# EasyEDA Pro project ProProject_Avaota Pi A_2024-03-25.epro, schematic Avaota Pi A, sheets 1 to 5 of 13 (continued)
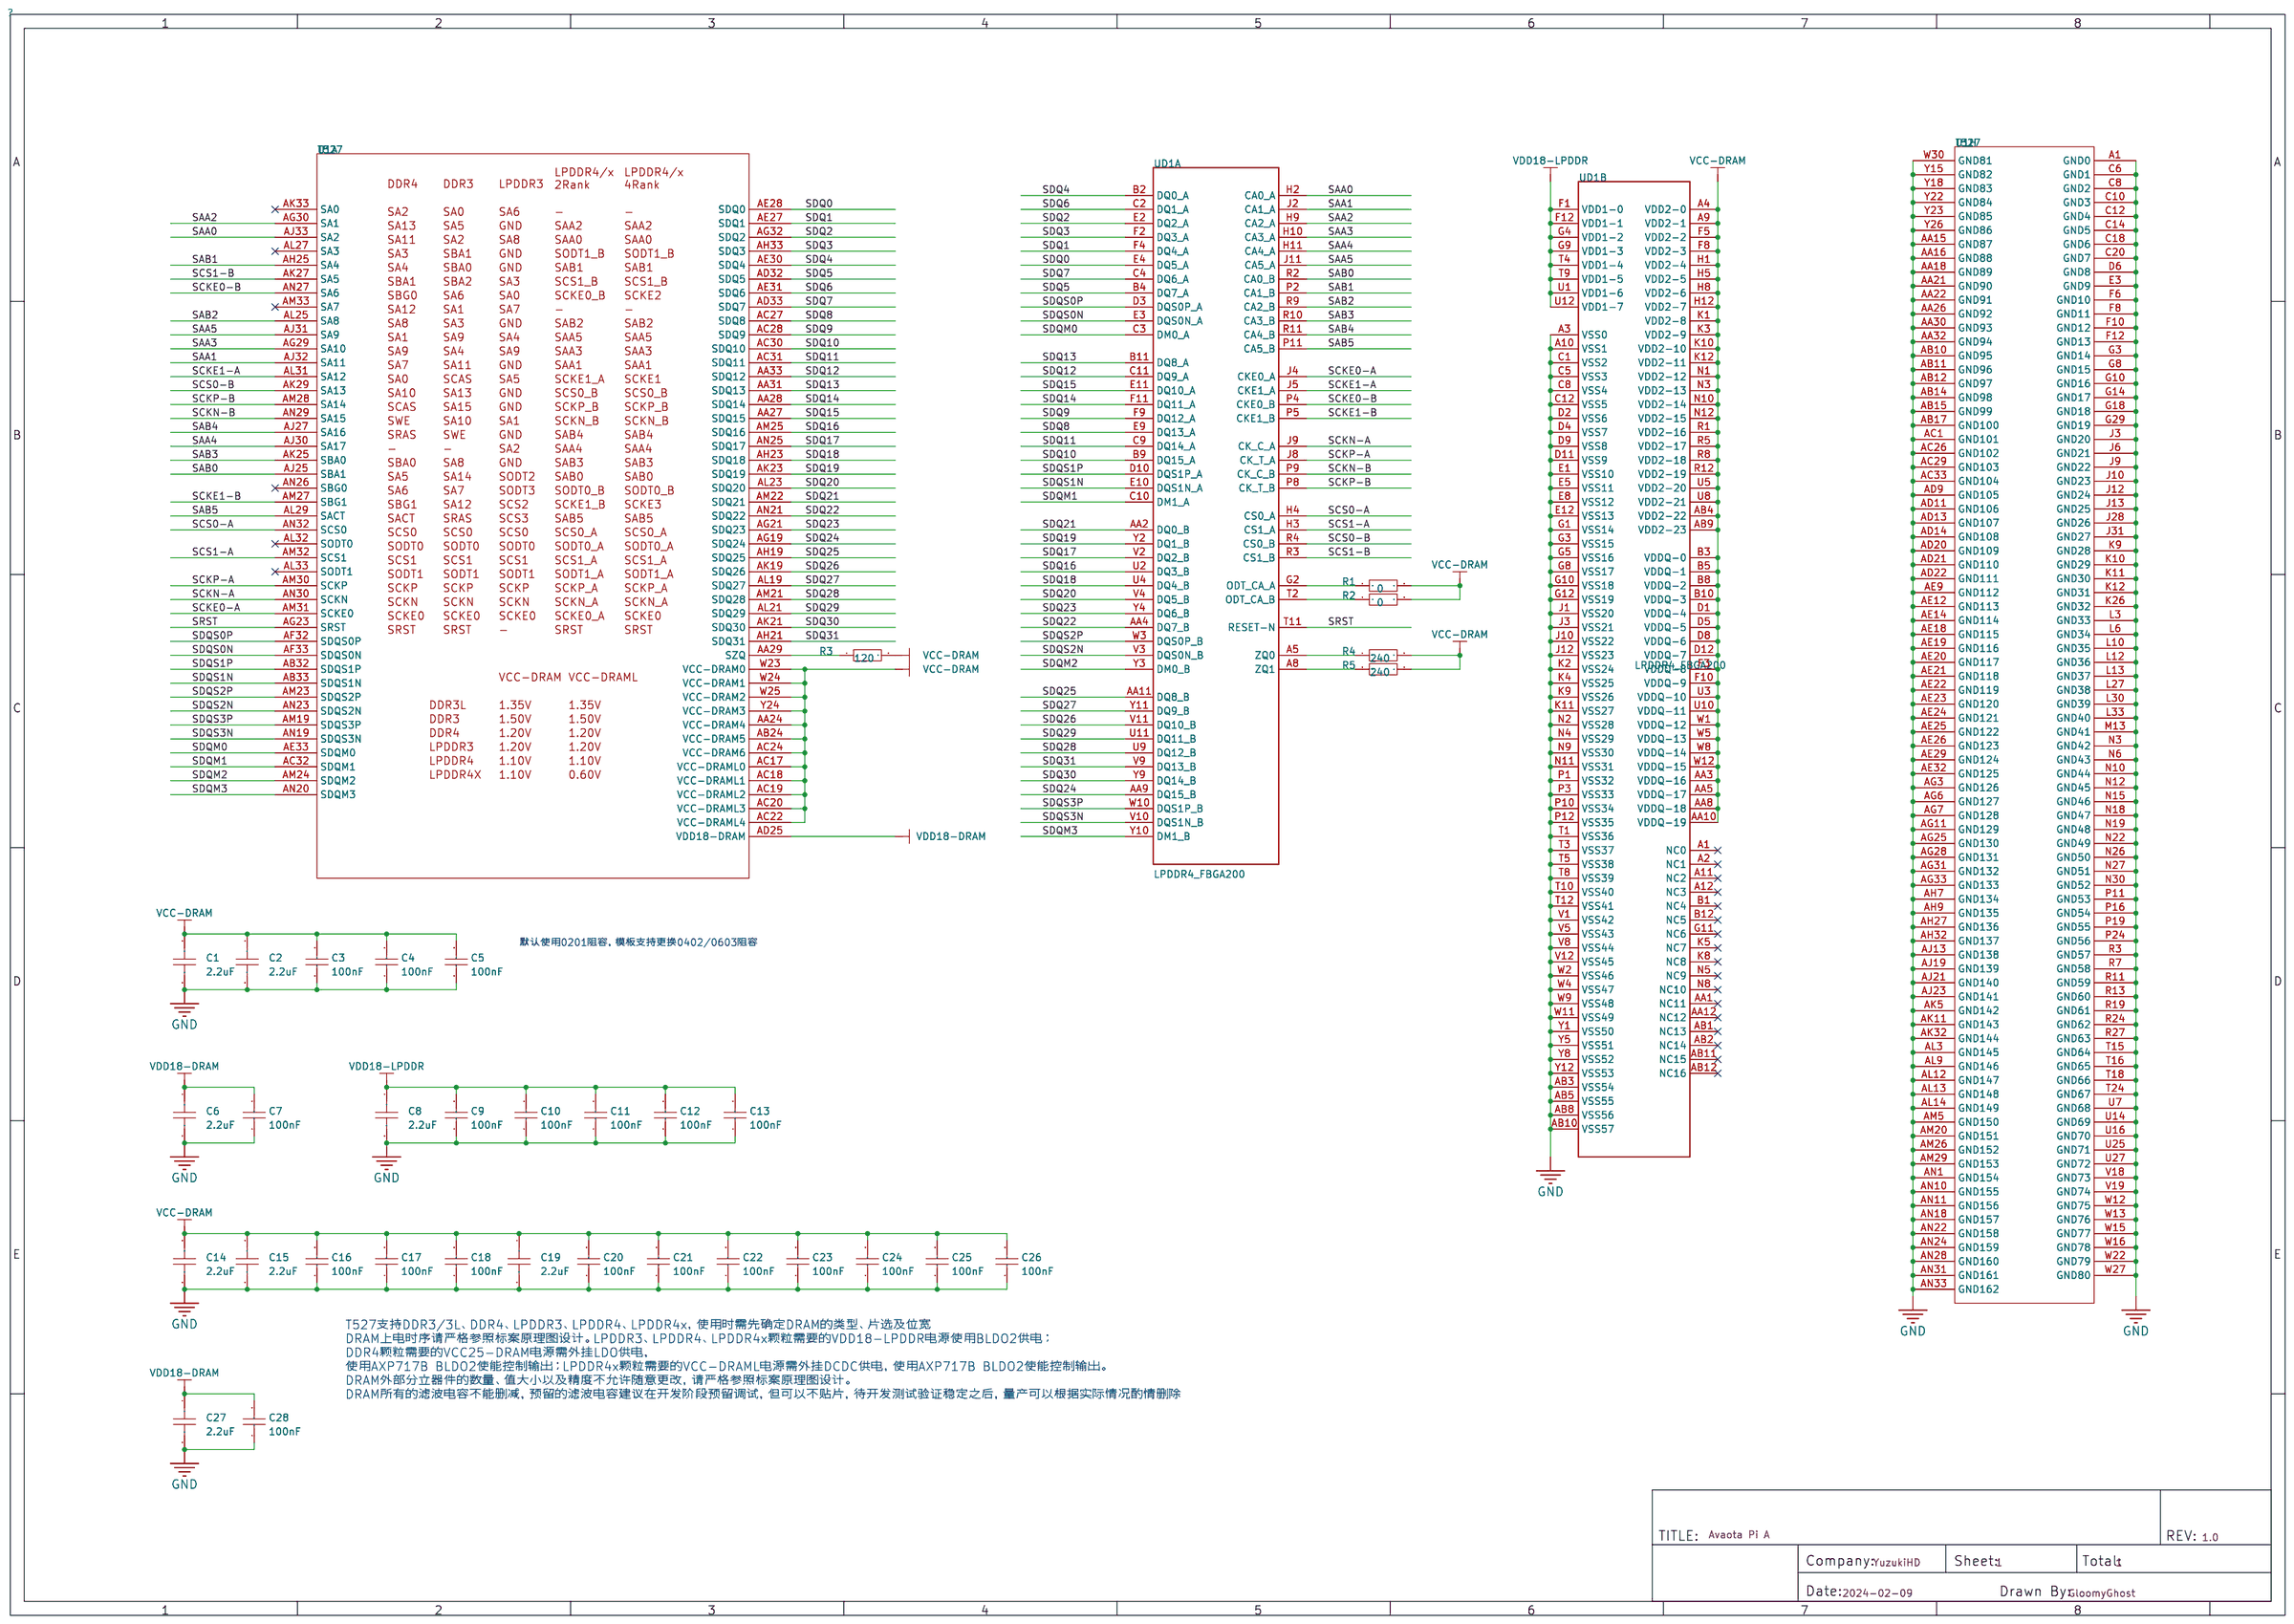
[diagram p0: schematic sheet]
## Nets (continued)
BLDO3: C63.1 C104.2 C185.2 C186.2 C187.2 C188.2 U4.21(BLDO3) U14.AJ5(CPVIN) U14.K13(VCC-MCSI) U14.M10(VCC-PK) ; also on sheet 6 13
BLDO4: C65.1 U4.22(BLDO4)
BOOT-SEL-ADC: R30.1 R33.2 U14.W1(GPADC0)
BT-RESETN: U14.U3(PG12/I2S1-LRCK/PG-EINT12) ; also on sheet 12
BT-WAKE-AP: U14.U5(PG10/I2S1-MCLK/PG-EINT10) ; also on sheet 12
CAN-RX0: U14.AJ17(PI16/UART3-CTS/TWI2-SDA/PWM-17/CAN-RX0/PI-EINT16) ; also on sheet 12
CAN-TX0: U14.AH17(PI15/UART3-RTS/TWI2-SCK/PWM-16/CAN-TX0/PI-EINT15) ; also on sheet 12
CLDO1: C60.2 C163.2 C164.2 U4.23(CLDO1) U14.U26(VCC-PC) ; also on sheet 8
CLDO2: C62.2 C91.2 U4.24(CLDO2) U14.R26(VCC-EFUSE)
CLDO3: C64.2 C102.2 C173.2 C174.2 U4.26(CLDO3) U14.AC9(VDD33) U14.L15(VCC-IO) ; also on sheet 6 8 9 10 12
CLDO4: C66.2 U4.27(CLDO4)
CPUSLDO: C13.1 C14.1 C35.2 U4.28(CPUSLDO) U14.AC15(VDD-CPUS)
CPUX-RX: U14.R29(PB10/UART0-RX/TWI0-SDA/PWM-1/I2S0-DIN3/I2S0-DOUT3/PB-EINT10) ; also on sheet 6 8
CPUX-TX: U14.R28(PB9/UART0-TX/TWI0-SCK/TRACE-DATA1/I2S0-DIN2/I2S0-DOUT2/PB-EINT9) ; also on sheet 6 8
CPVDD: C105.2 U14.AJ3(CPVDD)
CPVEE: C115.2 U14.AJ4(VEE) U14.AK2(CPVEE)
CTP-INT: U14.R31(PB12/TWI5-SDA/UART7-CTS/SPI1-CLK/PWM-3/PB-EINT12) ; also on sheet 8
CTP-RST: U14.R30(PB11/TWI5-SCK/UART7-RTS/SPI1-CS0/PWM-2/PB-EINT11) ; also on sheet 8
CTP-SCK: U14.R32(PB13/TWI4-SCK/UART7-TX/SPI1-MOSI/PWM-4/PB-EINT13) ; also on sheet 8
CTP-SDA: U14.R33(PB14/TWI4-SDA/UART7-RX/SPI1-MISO/PWM-5/PB-EINT14) ; also on sheet 8
DCDC1: C15.2 C16.2 C36.1 C37.1 C38.1 C39.1 C40.1 C41.1 C288.2 C289.2 L2.2 U14.W19(VDD-CPUL0) U14.W21(VDD-CPUL1) U14.Y19(VDD-CPUL2) U14.Y21(VDD-CPUL3)
DCDC2: C18.2 C25.2 C47.1 C48.1 C49.1 C50.1 C57.1 C58.1 C67.1 C68.1 C75.1 C76.1 C77.1 C78.1 C290.2 C291.2 L3.2 U14.N13(VDD-VE0) U14.N21(VDD-DE0) U14.P13(VDD-VE1) U14.P21(VDD-DE1) U14.P22(VDD-DE2) U14.R15(VDD-SYS0) U14.R17(VDD-SYS1) U14.R18(VDD-SYS2) U14.T11(VDD-GPU0) U14.T13(VDD-GPU1) U14.U12(VDD-GPU2) U14.U13(VDD-GPU3) ; also on sheet 6
DCDC3: C31.2 C33.2 C116.1 C117.1 C118.2 C119.2 C120.2 C121.2 C122.2 C123.2 C124.2 C125.2 C126.2 C127.2 C128.2 C129.2 C130.2 C131.2 C142.1 C143.1 C144.2 C145.2 C146.2 C147.1 C148.2 C149.2 C150.2 C151.2 C152.2 C153.2 C154.2 C155.2 C156.2 C157.2 C158.2 C159.2 C160.2 C292.2 C293.2 L4.2 R36.2 R37.2 R38.2 R39.2 R40.2 U4.29(FB3) U14.AA24(VCC-DRAM4) U14.AB24(VCC-DRAM5) U14.AC17(VCC-DRAML0) U14.AC18(VCC-DRAML1) U14.AC19(VCC-DRAML2) U14.AC20(VCC-DRAML3) U14.AC22(VCC-DRAML4) U14.AC24(VCC-DRAM6) U14.W23(VCC-DRAM0) U14.W24(VCC-DRAM1) U14.W25(VCC-DRAM2) U14.Y24(VCC-DRAM3) UD1.A4(VDD2-0) UD1.A9(VDD2-1) UD1.AA3(VDDQ-16) UD1.AA5(VDDQ-17) UD1.AA8(VDDQ-18) UD1.AA10(VDDQ-19) UD1.AB4(VDD2-22) UD1.AB9(VDD2-23) UD1.B3(VDDQ-0) UD1.B5(VDDQ-1) UD1.B8(VDDQ-2) UD1.B10(VDDQ-3) UD1.D1(VDDQ-4) UD1.D5(VDDQ-5) UD1.D8(VDDQ-6) UD1.D12(VDDQ-7) UD1.F3(VDDQ-8) UD1.F5(VDD2-2) UD1.F8(VDD2-3) UD1.F10(VDDQ-9) UD1.H1(VDD2-4) UD1.H5(VDD2-5) UD1.H8(VDD2-6) UD1.H12(VDD2-7) UD1.K1(VDD2-8) UD1.K3(VDD2-9) UD1.K10(VDD2-10) UD1.K12(VDD2-11) UD1.N1(VDD2-12) UD1.N3(VDD2-13) UD1.N10(VDD2-14) UD1.N12(VDD2-15) UD1.R1(VDD2-16) UD1.R5(VDD2-17) UD1.R8(VDD2-18) UD1.R12(VDD2-19) UD1.U3(VDDQ-10) UD1.U5(VDD2-20) UD1.U8(VDD2-21) UD1.U10(VDDQ-11) UD1.W1(VDDQ-12) UD1.W5(VDDQ-13) UD1.W8(VDDQ-14) UD1.W12(VDDQ-15)
DCDC4: C32.1 C34.1 C42.1 C167.2 C168.2 C169.2 C170.2 C175.2 C176.2 C177.2 C178.2 L5.1 R14.1 U14.AE16(VCC-PI) U14.L9(VCC-PE) U14.L26(VCC-PD) U14.P9(VCC-PJ) ; also on sheet 6 8 9 10 12 13
DCXO-XIN: C99.2 U14.AM13(DXIN) X1.1(OSC1)
DCXO-XOUT: C98.2 U14.AN13(DXOUT) X1.3(OSC2)
DDR-PARA-SEL-ADC1: R31.1 R34.2 U14.W2(GPADC1)
DDR-PARA-SEL-ADC2: R32.1 R35.2 U14.W3(GPADC2)
DSP-UART-RX: U14.AN2(PM1/S-UART0-RX/S-UART1-RX/S-PWM-3/S-PM-EINT1) ; also on sheet 8
DSP-UART-TX: U14.AN3(PM0/S-UART0-TX/S-UART1-TX/S-PWM-2/S-PM-EINT0) ; also on sheet 8
FEL: C96.2 R22.2 U14.F16(FEL)
HBIAS: U14.AL1(HBIAS) ; also on sheet 12
HP-DET: U14.AJ2(HP-DET) ; also on sheet 12
HPOUTFB: U14.AM1(HPOUTFB) ; also on sheet 12
HPOUTL: U14.AL2(HPOUTL) ; also on sheet 12
HPOUTR: U14.AM2(HPOUTR) ; also on sheet 12
IR-RX: U14.AL16(PI8/TWI5-SCK/IR-RX/PWM-9/SPI2-MOSI/PI-EINT8) ; also on sheet 12
LCD0-CLK: U14.K31(PD18/LCD0-CLK/LVDS1-D3P/DSI1-D3P/PWM-18/UART4-TX/PD-EINT18) ; also on sheet 8
LCD0-D0: U14.N28(PB0/UART2-TX/SPI2-CS0/JTAG-MS/LCD0-D0/PWM-6/PB-EINT0) ; also on sheet 8
LCD0-D1: U14.N29(PB1/UART2-RX/SPI2-CLK/JTAG-CK/LCD0-D1/PWM-7/PB-EINT1) ; also on sheet 8
LCD0-D2: U14.D32(PD0/LCD0-D2/LVDS0-D0P/DSI0-D0P/PWM-0/PD-EINT0) ; also on sheet 8
LCD0-D3: U14.D33(PD1/LCD0-D3/LVDS0-D0N/DSI0-D0N/PWM-1/PD-EINT1) ; also on sheet 8
LCD0-D4: U14.E30(PD2/LCD0-D4/LVDS0-D1P/DSI0-D1P/PWM-2/PD-EINT2) ; also on sheet 8
LCD0-D5: U14.E31(PD3/LCD0-D5/LVDS0-D1N/DSI0-D1N/PWM-3/PD-EINT3) ; also on sheet 8
LCD0-D6: U14.E32(PD4/LCD0-D6/LVDS0-D2P/DSI0-CKP/PWM-4/PD-EINT4) ; also on sheet 8
LCD0-D7: U14.E33(PD5/LCD0-D7/LVDS0-D2N/DSI0-CKN/PWM-5/PD-EINT5) ; also on sheet 8
LCD0-D8: U14.M31(PB2/UART2-RTS/SPI2-MOSI/JTAG-DO/LCD0-D8/CAN-TX0/PB-EINT2) ; also on sheet 8
LCD0-D9: U14.M32(PB3/UART2-CTS/SPI2-MISO/JTAG-DI/LCD0-D9/CAN-RX0/PB-EINT3) ; also on sheet 8
LCD0-D10: U14.F32(PD6/LCD0-D10/LVDS0-CKP/DSI0-D2P/PWM-6/PD-EINT6) ; also on sheet 8
LCD0-D11: U14.F33(PD7/LCD0-D11/LVDS0-CKN/DSI0-D2N/PWM-7/PD-EINT7) ; also on sheet 8
LCD0-D12: U14.G30(PD8/LCD0-D12/LVDS0-D3P/DSI0-D3P/PWM-8/PD-EINT8) ; also on sheet 8
LCD0-D13: U14.G31(PD9/LCD0-D13/LVDS0-D3N/DSI0-D3N/PWM-9/PD-EINT9) ; also on sheet 8
LCD0-D14: U14.G32(PD10/LCD0-D14/LVDS1-D0P/DSI1-D0P/PWM-10/SPI1-CS0/DBI-CSX/PD-EINT10) ; also on sheet 8
LCD0-D15: U14.G33(PD11/LCD0-D15/LVDS1-D0N/DSI1-D0N/PWM-11/SPI1-CLK/DBI-SCLK/PD-EINT11) ; also on sheet 8
LCD0-D16: U14.P31(PB7/OWA-IN/I2S0-DOUT0/I2S0-DIN1/LCD0-D16/PWM-11/PB-EINT7) ; also on sheet 8
LCD0-D17: U14.P32(PB8/OWA-OUT/I2S0-DIN0/I2S0-DOUT1/LCD0-D17/PWM-0/PB-EINT8) ; also on sheet 8
LCD0-D18: U14.H31(PD12/LCD0-D18/LVDS1-D1P/DSI1-D1P/PWM-12/SPI1-MOSI/DBI-SDO/PD-EINT12) ; also on sheet 8
LCD0-D19: U14.H32(PD13/LCD0-D19/LVDS1-D1N/DSI1-D1N/PWM-13/SPI1-MISO/DBI-SDI/DBI-TE/DBI-DCX/PD-EINT13) ; also on sheet 8
LCD0-D20: U14.J29(PD14/LCD0-D20/LVDS1-D2P/DSI1-CKP/PWM-14/UART3-TX/PD-EINT14) ; also on sheet 8
LCD0-D21: U14.J30(PD15/LCD0-D21/LVDS1-D2N/DSI1-CKN/PWM-15/UART3-RX/PD-EINT15) ; also on sheet 8
LCD0-D22: U14.J32(PD16/LCD0-D22/LVDS1-CKP/DSI1-D2P/PWM-16/UART3-RTS/PD-EINT16) ; also on sheet 8
LCD0-D23: U14.J33(PD17/LCD0-D23/LVDS1-CKN/DSI1-D2N/PWM-17/UART3-CTS/PD-EINT17) ; also on sheet 8
LCD0-DE: U14.K32(PD19/LCD0-DE/LVDS1-D3N/DSI1-D3N/PWM-19/UART4-RX/PD-EINT19) ; also on sheet 8
LCD0-HSYNC: U14.L28(PD20/LCD0-HSYNC/PWM-2/UART2-TX/UART7-RTS/UART4-RTS/PD-EINT20) ; also on sheet 8
LCD0-PWM: U14.L31(PD22/PWM-1/SPI1-HOLD/DBI-DCX/DBI-WRX/UART2-RTS/UART7-TX/TWI0-SCK/PD-EINT22) ; also on sheet 8
LCD0-RST: U14.L32(PD23/PWM-0/SPI1-WP/DBI-TE/UART2-CTS/UART7-RX/TWI0-SDA/PD-EINT23) ; also on sheet 8
LCD0-VSYNC: U14.L29(PD21/LCD0-VSYNC/PWM-3/UART2-RX/UART7-CTS/UART4-CTS/PD-EINT21) ; also on sheet 8
LEDC: U14.C13(PH19/IR-RX/I2S3-DOUT3/I2S3-DIN3/LEDC/PCIE0-CLKREQN/PH-EINT19) ; also on sheet 8
MCSI0-CKN: U14.A10(PK4/MCSIA-CKN/TWI2-SCK/PK-EINT4) ; also on sheet 13
MCSI0-CKP: U14.B10(PK5/MCSIA-CKP/TWI2-SDA/PK-EINT5) ; also on sheet 13
MCSI0-D0N: U14.A12(PK0/MCSIA-D0N/PK-EINT0) ; also on sheet 13
MCSI0-D0P: U14.B12(PK1/MCSIA-D0P/PK-EINT1) ; also on sheet 13
MCSI0-D1N: U14.B11(PK2/MCSIA-D1N/PK-EINT2) ; also on sheet 13
MCSI0-D1P: U14.C11(PK3/MCSIA-D1P/PK-EINT3) ; also on sheet 13
MCSI0-D2N: U14.E12(PK6/MCSIB-D0N/PK-EINT6) ; also on sheet 13
MCSI0-D2P: U14.D12(PK7/MCSIB-D0P/PK-EINT7) ; also on sheet 13
MCSI0-D3N: U14.E10(PK8/MCSIB-D1N/PK-EINT8) ; also on sheet 13
MCSI0-D3P: U14.D10(PK9/MCSIB-D1P/PK-EINT9) ; also on sheet 13
MCSI0-MCLK: U14.A6(PK18/MCSID-D0N/MCSI0-MCLK/UART6-TX/NCSI-D2/PK-EINT18) ; also on sheet 13
MCSI0-PWDN: U14.B4(PK23/MCSID-CKP/TWI3-SDA/PWM-7/NCSI-D7/PK-EINT23) ; also on sheet 13
MCSI0-RSTN: U14.A4(PK22/MCSID-CKN/TWI3-SCK/PWM-6/NCSI-D6/PK-EINT22) ; also on sheet 13
MCSI0-SCK: U14.E8(PK10/MCSIB-CKN/TWI3-SCK/PK-EINT10) ; also on sheet 13
MCSI0-SDA: U14.D8(PK11/MCSIB-CKP/TWI3-SDA/PK-EINT11) ; also on sheet 13
MCSI0-USER: U14.B5(PK21/MCSID-D1P/MCSI1-MCLK/UART6-CTS/NCSI-D5/PK-EINT21) ; also on sheet 13
MICIN3N: U14.AF1(MICIN3N) ; also on sheet 12
MICIN3P: U14.AF2(MICIN3P) ; also on sheet 12
PE0: U14.E6(PE0/MCSI0-MCLK/PE-EINT0) ; also on sheet 8
PE1: U14.C4(PE1/TWI2-SCK/UART4-TX/PE-EINT1) ; also on sheet 8
PE2: U14.E5(PE2/TWI2-SDA/UART4-RX/PE-EINT2) ; also on sheet 8
PE3: U14.E4(PE3/TWI3-SCK/UART4-RTS/PE-EINT3) ; also on sheet 8
PE4: U14.C3(PE4/TWI3-SDA/UART4-CTS/PE-EINT4) ; also on sheet 8
PE5: U14.B3(PE5/MCSI1-MCLK/PLL-LOCK-DBG/I2S2-MCLK/LEDC/PE-EINT5) ; also on sheet 8
PE6: U14.A3(PE6/I2S2-BCLK/LCD0-TRIG/NCSI-D8/PE-EINT6) ; also on sheet 8
PE7: U14.A2(PE7/I2S2-LRCK/LCD1-TRIG/NCSI-D9/PE-EINT7) ; also on sheet 8
PE8: U14.B2(PE8/I2S2-DOUT0/LCD2-TRIG/NCSI-D10/PE-EINT8) ; also on sheet 8
PE9: U14.B1(PE9/I2S2-DIN0/NCSI-D11/PE-EINT9) ; also on sheet 8
PE10: U14.C2(PE10/MCSI3-MCLK/PWM-3/NCSI-D12/PE-EINT10) ; also on sheet 8
PE11: U14.J7(PE11/TWI1-SCK/UART5-RTS/SPI2-CS0/UART6-TX/NCSI-D13/PE-EINT11) ; also on sheet 8
PE12: U14.C1(PE12/TWI1-SDA/UART5-CTS/SPI2-CLK/UART6-RX/NCSI-D14/PE-EINT12) ; also on sheet 8
PE13: U14.G6(PE13/TWI4-SCK/UART5-TX/SPI2-MOSI/UART6-RTS/CSI0-XVS-FSYNC/PE-EINT13) ; also on sheet 8
PE14: U14.L7(PE14/TWI4-SDA/UART5-RX/SPI2-MISO/UART6-CTS/CSI1-XVS-FSYNC/PE-EINT14) ; also on sheet 8
PE15: U14.N7(PE15/MCSI2-MCLK/PWM-2/NCSI-D15/PE-EINT15) ; also on sheet 8
PGAOUT0: R26.1 U14.U8(PGAOUT0)
PGAOUT1: R27.1 U14.U10(PGAOUT1)
PHYRSTB0: U14.D16(PH8/DMIC-CLK/SPI2-CS0/I2S2-MCLK/I2S2-DIN2/PH-EINT8) ; also on sheet 9
PHYRSTB1: U14.J1(PJ16/LCD1-D16/LVDS3-CKP/PJ-EINT16) ; also on sheet 10
PMU-SCK: R11.2 U4.52(SCK) U5.6(SCL) U14.AN6(PL0/S-TWI0-SCK/S-PL-EINT0)
PMU-SDA: R12.2 U4.51(SDA) U5.5(SDA) U14.AN5(PL1/S-TWI0-SDA/S-PL-EINT1)
PS: C12.1 C17.1 C26.1 C29.1 C30.1 C46.1 C55.1 C56.2 C70.2 C79.2 C82.2 C283.2 C284.2 C285.2 C286.2 C287.2 U4.9(VIN1) U4.15(ALDOIN) U4.20(BLDOIN) U4.25(CLDOIN) U4.31(VIN3) U4.32(VIN2) U4.43(VSYS_1) U4.44(VSYS_2) U4.47(VMID_1) U4.48(VMID_2) U5.2(VIN3) U5.17(VIN1) U5.20(VIN2)
PWRON: C11.1 C97.2 R23.2 U4.6(PWRON)
RGMII0-CLKIN: U14.C17(PH3/TWI1-SDA/IR-TX/I2S2-DIN2/RGMII0-CLKIN/RMII0-RXER/I2S2-DOUT2/PH-EINT3) ; also on sheet 9
RGMII0-MDC: U14.C16(PH9/DMIC-DATA0/SPI2-CLK/I2S2-BCLK/RGMII0-MDC/PH-EINT9) ; also on sheet 9
RGMII0-MDIO: U14.B16(PH10/DMIC-DATA1/SPI2-MOSI/I2S2-LRCK/RGMII0-MDIO/PH-EINT10) ; also on sheet 9
RGMII0-RXCK: U14.B14(PH16/I2S3-DOUT0/I2S3-DIN1/RGMII0-RXCK/RMII0-NULL/CLK-FANOUT0/PH-EINT16) ; also on sheet 9
RGMII0-RXCTL: U14.D18(PH2/TWI1-SCK/CPU-CUR-W/I2S2-DIN3/RGMII0-RXCTL/RMII0-CRS-DV/I2S2-DOUT3/PH-EINT2) ; also on sheet 9
RGMII0-RXD0: U14.E18(PH1/TWI0-SDA/RGMII0-RXD0/RMII0-RXD0/PH-EINT1) ; also on sheet 9
RGMII0-RXD1: U14.F18(PH0/TWI0-SCK/RGMII0-RXD1/RMII0-RXD1/PH-EINT0) ; also on sheet 9
RGMII0-RXD2: U14.D14(PH15/I2S3-LRCK/RGMII0-RXD2/RMII0-NULL/PH-EINT15) ; also on sheet 9
RGMII0-RXD3: U14.E14(PH14/I2S3-BCLK/RGMII0-RXD3/RMII0-NULL/PH-EINT14) ; also on sheet 9
RGMII0-TXCK: U14.G12(PH6/UART3-RTS/SPI1-MOSI/OWA-IN/RGMII0-TXCK/RMII0-TXCK/PH-EINT6) ; also on sheet 9
RGMII0-TXCTL: U14.F14(PH7/UART3-CTS/SPI1-MISO/OWA-OUT/RGMII0-TXCTL/RMII0-TXEN/PH-EINT7) ; also on sheet 9
RGMII0-TXD0: U14.E16(PH5/UART3-RX/SPI1-CLK/LEDC/RGMII0-TXD0/RMII0-TXD0/PH-EINT5) ; also on sheet 9
RGMII0-TXD1: U14.B17(PH4/UART3-TX/SPI1-CS0/CPU-CUR-W/RGMII0-TXD1/RMII0-TXD1/PH-EINT4) ; also on sheet 9
RGMII0-TXD2: U14.A14(PH18/IR-TX/I2S3-DOUT2/I2S3-DIN2/RGMII0-TXD2/RMII0-NULL/PH-EINT18) ; also on sheet 9
RGMII0-TXD3: U14.B13(PH17/I2S3-DOUT1/I2S3-DIN0/RGMII0-TXD3/RMII0-NULL/PH-EINT17) ; also on sheet 9
RGMII1-CLKIN: U14.E2(PJ3/LCD1-D3/LVDS2-D1N/RGMII1-CLKIN/RMII1-RXER/PJ-EINT3) ; also on sheet 10
RGMII1-MDC: U14.H2(PJ8/LCD1-D8/LVDS2-D3P/RGMII1-MDC/PJ-EINT8) ; also on sheet 10
RGMII1-MDIO: U14.H3(PJ9/LCD1-D9/LVDS2-D3N/RGMII1-MDIO/PJ-EINT9) ; also on sheet 10
RGMII1-RXCK: U14.J5(PJ13/LCD1-D13/LVDS3-D1N/RGMII1-RXCK/RMII1-NULL/PJ-EINT13) ; also on sheet 10
RGMII1-RXCTL: U14.E1(PJ2/LCD1-D2/LVDS2-D1P/RGMII1-RXCTL/RMII1-CRS-DV/PJ-EINT2) ; also on sheet 10
RGMII1-RXD0: U14.D2(PJ1/LCD1-D1/LVDS2-D0N/RGMII1-RXD0/RMII1-RXD0/PJ-EINT1) ; also on sheet 10
RGMII1-RXD1: U14.D1(PJ0/LCD1-D0/LVDS2-D0P/RGMII1-RXD1/RMII1-RXD1/PJ-EINT0) ; also on sheet 10
RGMII1-RXD2: U14.J4(PJ12/LCD1-D12/LVDS3-D1P/RGMII1-RXD2/RMII1-NULL/PJ-EINT12) ; also on sheet 10
RGMII1-RXD3: U14.G5(PJ11/LCD1-D11/LVDS3-D0N/RGMII1-RXD3/RMII1-NULL/PJ-EINT11) ; also on sheet 10
RGMII1-TXCK: U14.G1(PJ6/LCD1-D6/LVDS2-CKP/RGMII1-TXCK/RMII1-TXCK/PJ-EINT6) ; also on sheet 10
RGMII1-TXCTL: U14.G2(PJ7/LCD1-D7/LVDS2-CKN/RGMII1-TXCTL/RMII1-TXEN/PJ-EINT7) ; also on sheet 10
RGMII1-TXD0: U14.F2(PJ5/LCD1-D5/LVDS2-D2N/RGMII1-TXD0/RMII1-TXD0/PJ-EINT5) ; also on sheet 10
RGMII1-TXD1: U14.F1(PJ4/LCD1-D4/LVDS2-D2P/RGMII1-TXD1/RMII1-TXD1/PJ-EINT4) ; also on sheet 10
RGMII1-TXD2: U14.L5(PJ15/LCD1-D15/LVDS3-D2N/RGMII1-TXD2/RMII1-NULL/PJ-EINT15) ; also on sheet 10
RGMII1-TXD3: U14.L4(PJ14/LCD1-D14/LVDS3-D2P/RGMII1-TXD3/RMII1-NULL/PJ-EINT14) ; also on sheet 10
SAA0: U14.AJ33(SA2) UD1.H2(CA0_A)
SAA1: U14.AJ32(SA11) UD1.J2(CA1_A)
SAA2: U14.AG30(SA1) UD1.H9(CA2_A)
SAA3: U14.AG29(SA10) UD1.H10(CA3_A)
SAA4: U14.AJ30(SA17) UD1.H11(CA4_A)
SAA5: U14.AJ31(SA9) UD1.J11(CA5_A)
SAB0: U14.AJ25(SBA1) UD1.R2(CA0_B)
SAB1: U14.AH25(SA4) UD1.P2(CA1_B)
SAB2: U14.AL25(SA8) UD1.R9(CA2_B)
SAB3: U14.AK25(SBA0) UD1.R10(CA3_B)
SAB4: U14.AJ27(SA16) UD1.R11(CA4_B)
SAB5: U14.AL29(SACT) UD1.P11(CA5_B)
SCKE0-A: U14.AM31(SCKE0) UD1.J4(CKE0_A)
SCKE0-B: U14.AN27(SA6) UD1.P4(CKE0_B)
SCKE1-A: U14.AL31(SA12) UD1.J5(CKE1_A)
SCKE1-B: U14.AM27(SBG1) UD1.P5(CKE1_B)
SCKN-A: U14.AN30(SCKN) UD1.J9(CK_C_A)
SCKN-B: U14.AN29(SA15) UD1.P9(CK_C_B)
SCKP-A: U14.AM30(SCKP) UD1.J8(CK_T_A)
SCKP-B: U14.AM28(SA14) UD1.P8(CK_T_B)
SCS0-A: U14.AN32(SCS0) UD1.H4(CS0_A)
SCS0-B: U14.AK29(SA13) UD1.R4(CS0_B)
SCS1-A: U14.AM32(SCS1) UD1.H3(CS1_A)
SCS1-B: U14.AK27(SA5) UD1.R3(CS1_B)
SDC0-CLK: R42.2 ; also on sheet 8
SDC0-CMD: U14.B19(PF3/SDC0-CMD/JTAG-DO/TRACE-DATA0/I2S3-LRCK/PF-EINT3) ; also on sheet 8
SDC0-D0: U14.A20(PF1/SDC0-D0/JTAG-DI/TRACE-DATA1/I2S3-DOUT0/I2S3-DIN1/PF-EINT1) ; also on sheet 8
SDC0-D1: U14.B20(PF0/SDC0-D1/JTAG-MS/TRACE-DATA2/I2S3-DIN0/I2S3-DOUT1/PF-EINT0) ; also on sheet 8
SDC0-D2: U14.A18(PF5/SDC0-D2/JTAG-CK/TRACE-CLK/I2S3-BCLK/PF-EINT5) ; also on sheet 8
SDC0-D3: U14.B18(PF4/SDC0-D3/UART0-RX/I2S3-DIN3/I2S3-DOUT3/PF-EINT4) ; also on sheet 8
SDC0-DET: U14.D20(PF6/I2S3-MCLK/PF-EINT6) ; also on sheet 8
SDC1-CLK: R43.2 ; also on sheet 12
SDC1-CMD: U14.R2(PG1/SDC1-CMD/PG-EINT1) ; also on sheet 12
SDC1-D0: U14.P3(PG2/SDC1-D0/PCIE0-PERSTN/PG-EINT2) ; also on sheet 12
SDC1-D1: U14.P2(PG3/SDC1-D1/PCIE0-WAKEN/PG-EINT3) ; also on sheet 12
SDC1-D2: U14.T3(PG4/SDC1-D2/PCIE0-CLKREQN/PG-EINT4) ; also on sheet 12
SDC1-D3: U14.T2(PG5/SDC1-D3/PG-EINT5) ; also on sheet 12
SDC2-CLK: R41.1 ; also on sheet 8
SDC2-CMD: U14.W33(PC6/NAND-RB0/SDC2-CMD/PC-EINT6) ; also on sheet 8
SDC2-D0: U14.V32(PC10/NAND-DQ5/SDC2-D0/SPIF-D5/PC-EINT10) ; also on sheet 8
SDC2-D1: U14.U32(PC13/NAND-DQ3/SDC2-D1/PC-EINT13) ; also on sheet 8
SDC2-D2: U14.T32(PC15/NAND-DQ1/SDC2-D2/SPI0-WP/SPIF-WP/PC-EINT15) ; also on sheet 8
SDC2-D3: U14.W32(PC8/NAND-DQ7/SDC2-D3/SPIF-D7/PC-EINT8) ; also on sheet 8
SDC2-D4: U14.W31(PC9/NAND-DQ6/SDC2-D4/SPIF-D6/PC-EINT9) ; also on sheet 8
SDC2-D5: U14.V31(PC11/NAND-DQ4/SDC2-D5/SPIF-D4/PC-EINT11) ; also on sheet 8
SDC2-D6: U14.U31(PC14/NAND-DQ2/SDC2-D6/PC-EINT14) ; also on sheet 8
SDC2-D7: U14.T31(PC16/NAND-DQ0/SDC2-D7/SPI0-HOLD/SPIF-HOLD/PC-EINT16) ; also on sheet 8
SDC2-DS: U14.W28(PC0/NAND-WE/SDC2-DS/PC-EINT0) ; also on sheet 8
SDC2-RST: U14.Y31(PC1/NAND-ALE/SDC2-RST/PC-EINT1) ; also on sheet 8
SDQ0: U14.AE28(SDQ0) UD1.E4(DQ5_A)
SDQ1: U14.AE27(SDQ1) UD1.F4(DQ4_A)
SDQ2: U14.AG32(SDQ2) UD1.E2(DQ2_A)
SDQ3: U14.AH33(SDQ3) UD1.F2(DQ3_A)
SDQ4: U14.AE30(SDQ4) UD1.B2(DQ0_A)
SDQ5: U14.AD32(SDQ5) UD1.B4(DQ7_A)
SDQ6: U14.AE31(SDQ6) UD1.C2(DQ1_A)
SDQ7: U14.AD33(SDQ7) UD1.C4(DQ6_A)
SDQ8: U14.AC27(SDQ8) UD1.E9(DQ13_A)
SDQ9: U14.AC28(SDQ9) UD1.F9(DQ12_A)
SDQ10: U14.AC30(SDQ10) UD1.B9(DQ15_A)
SDQ11: U14.AC31(SDQ11) UD1.C9(DQ14_A)
SDQ12: U14.AA33(SDQ12) UD1.C11(DQ9_A)
SDQ13: U14.AA31(SDQ13) UD1.B11(DQ8_A)
SDQ14: U14.AA28(SDQ14) UD1.F11(DQ11_A)
SDQ15: U14.AA27(SDQ15) UD1.E11(DQ10_A)
SDQ16: U14.AM25(SDQ16) UD1.U2(DQ3_B)
SDQ17: U14.AN25(SDQ17) UD1.V2(DQ2_B)
SDQ18: U14.AH23(SDQ18) UD1.U4(DQ4_B)
SDQ19: U14.AK23(SDQ19) UD1.Y2(DQ1_B)
SDQ20: U14.AL23(SDQ20) UD1.V4(DQ5_B)
SDQ21: U14.AM22(SDQ21) UD1.AA2(DQ0_B)
SDQ22: U14.AN21(SDQ22) UD1.AA4(DQ7_B)
SDQ23: U14.AG21(SDQ23) UD1.Y4(DQ6_B)
SDQ24: U14.AG19(SDQ24) UD1.AA9(DQ15_B)
SDQ25: U14.AH19(SDQ25) UD1.AA11(DQ8_B)
SDQ26: U14.AK19(SDQ26) UD1.V11(DQ10_B)
SDQ27: U14.AL19(SDQ27) UD1.Y11(DQ9_B)
SDQ28: U14.AM21(SDQ28) UD1.U9(DQ12_B)
SDQ29: U14.AL21(SDQ29) UD1.U11(DQ11_B)
SDQ30: U14.AK21(SDQ30) UD1.Y9(DQ14_B)
SDQ31: U14.AH21(SDQ31) UD1.V9(DQ13_B)
SDQM0: U14.AE33(SDQM0) UD1.C3(DM0_A)
SDQM1: U14.AC32(SDQM1) UD1.C10(DM1_A)
SDQM2: U14.AM24(SDQM2) UD1.Y3(DM0_B)
SDQM3: U14.AN20(SDQM3) UD1.Y10(DM1_B)
SDQS0N: U14.AF33(SDQS0N) UD1.E3(DQS0N_A)
SDQS0P: U14.AF32(SDQS0P) UD1.D3(DQS0P_A)
SDQS1N: U14.AB33(SDQS1N) UD1.E10(DQS1N_A)
SDQS1P: U14.AB32(SDQS1P) UD1.D10(DQS1P_A)
SDQS2N: U14.AN23(SDQS2N) UD1.V3(DQS0N_B)
SDQS2P: U14.AM23(SDQS2P) UD1.W3(DQS0P_B)
SDQS3N: U14.AN19(SDQS3N) UD1.V10(DQS1N_B)
SDQS3P: U14.AM19(SDQS3P) UD1.W10(DQS1P_B)
SPI0-CLK: R123.1 ; also on sheet 12
SPI0-CS: U14.K3(PJ20/LCD1-D20/UART2-TX/UART3-RTS/SPI0-CS0/PJ-EINT20) ; also on sheet 12
SPI0-HOLD: U14.N2(PJ26/LCD1-HSYNC/TWI5-SCK/UART4-RTS/SPI0-HOLD/PJ-EINT26) ; also on sheet 12
SPI0-MISO: U14.L1(PJ23/LCD1-D23/UART2-CTS/UART3-RX/SPI0-MISO/PJ-EINT23) ; also on sheet 12
SPI0-MOSI: U14.L2(PJ22/LCD1-D22/UART2-RTS/UART3-TX/SPI0-MOSI/PJ-EINT22) ; also on sheet 12
SPI0-WP: U14.M2(PJ25/LCD1-DE/TWI4-SDA/UART4-RX/SPI0-WP/PJ-EINT25) ; also on sheet 12
SPI-LCD-BLK: U14.AN9(PL8/S-TWI1-SCK/S-DJTAG-MS/S-RJTAG-MS/I2S0-MCLK/DMIC-DATA0/S-PL-EINT8) ; also on sheet 8
SPI-LCD-CLK: U14.AJ9(PL11/S-IR-RX/S-DJTAG-DI/S-RJTAG-DI/DMIC-DATA1/S-SPI0-CLK/S-PL-EINT11) ; also on sheet 8
SPI-LCD-CS: U14.AK9(PL10/S-PWM-0/S-DJTAG-DO/S-RJTAG-DO/DMIC-DATA0/S-SPI0-CS0/S-PL-EINT10) ; also on sheet 8
SPI-LCD-DC: U14.AJ7(PL13/S-TWI2-SDA/S-PWM-9/S-UART0-RX/DMIC-DATA3/S-SPI0-MISO/S-PL-EINT13) ; also on sheet 8
SPI-LCD-MOSI: U14.AK7(PL12/S-TWI2-SCK/S-PWM-8/S-UART0-TX/DMIC-DATA2/S-SPI0-MOSI/S-PL-EINT12) ; also on sheet 8
SPI-LCD-RST: U14.AM9(PL9/S-TWI1-SDA/S-DJTAG-CK/S-RJTAG-CK/S-PWM-1/DMIC-CLK/S-PL-EINT9) ; also on sheet 8
SRST: U14.AG23(SRST) UD1.T11(RESET-N)
STWI1-SCK: U14.AM4(PM2/S-TWI1-SCK/S-RJTAG-MS/S-PWM-6/S-PM-EINT2) ; also on sheet 8
STWI1-SDA: U14.AM3(PM3/S-TWI1-SDA/S-RJTAG-CK/S-PWM-7/S-PM-EINT3) ; also on sheet 8
UART1-CTS: U14.U6(PG9/UART1-CTS/PG-EINT9) ; also on sheet 12
UART1-RTS: U14.R4(PG8/UART1-RTS/PG-EINT8) ; also on sheet 12
UART1-RX: U14.R5(PG7/UART1-RX/PG-EINT7) ; also on sheet 12
UART1-TX: U14.R6(PG6/UART1-TX/PG-EINT6) ; also on sheet 12
USB0-DRVVBUS: U14.AL17(PI12/UART3-RX/PWM-13/SPI2-MISO/PI-EINT12) ; also on sheet 6
USB0-VBUSDET: U14.AK17(PI13/UART6-CTS/DMIC-DATA3/PWM-14/I2S2-MCLK/PI-EINT13) ; also on sheet 6
VCM-ADC: C112.2 U14.Y9(VCM-ADC)
VRA1: C109.2 U14.AG5(VRA1)
VRA2: C110.2 U14.AG4(VRA2)
VREFP-ADC: C113.2 R24.1 U14.AA9(VREFP-ADC)
VRP: C111.2 U14.AC7(VRP)
WL-REG-ON: U14.U2(PG13/I2S1-DOUT0/I2S1-DIN1/PG-EINT13) ; also on sheet 12
WL-WAKE-AP: U14.U1(PG14/I2S1-DIN0/I2S1-DOUT1/PG-EINT14) ; also on sheet 12
X32KIN: C100.2 R25.1 U14.AM12(X32KIN) X2.1
X32KOUT: C101.2 R25.2 U14.AM11(X32KOUT) X2.2
$1N3706: L2.1 U4.10(LX1_1) U4.11(LX1_2)
$1N3718: L3.1 U4.33(LX2)
$1N3723: L4.1 U4.30(LX3)
$1N3725: C43.1 U4.7(VREF)
$1N4703: R13.2 U4.39(TS)
$1N4773: C44.2 U4.41(BAT_1) U4.42(BAT_2)
$1N4806: R14.2 U4.38(CHGLED)
$1N4992: L5.2 U4.45(SW_1) U4.46(SW_2)
$1N6251: L6.1 U5.18(LX1)
$1N6517: L7.1 U5.19(LX2)
$1N6728: L8.1 U5.3(LX3)
$1N7320: C88.1 U5.8(VREF)
$1N42597: LED1.1(A) R17.1
$2N1846: R21.1 SW1.4
$2N1994: R22.1 SW2.4
$2N2360: R19.1 U14.V3(LRADC0)
$2N2431: R20.1 U14.V2(LRADC1)
$2N7803: R23.1 SW3.4
$3N7591: R38.1 U14.AA29(SZQ)
$3N7643: R39.1 UD1.A5(ZQ0)
$3N7644: R40.1 UD1.A8(ZQ1)
$3N7648: R36.1 UD1.G2(ODT_CA_A)
$3N7649: R37.1 UD1.T2(ODT_CA_B)
$4N500: R41.2 U14.Y32(PC5/NAND-RE/SDC2-CLK/PC-EINT5)
$4N609: R42.1 U14.C19(PF2/SDC0-CLK/UART0-TX/I2S3-DIN2/I2S3-DOUT2/PF-EINT2)
$4N713: R43.1 U14.R1(PG0/SDC1-CLK/PG-EINT0)
$5N3909: R123.2 U14.K2(PJ21/LCD1-D21/UART2-RX/UART3-CTS/SPI0-CLK/PJ-EINT21)

Not connected (* = marked no-connect by the designer): U4 2(DM)* 3(DP)* 4(CC1)* 5(CC2)* 36(BACKUP)* 40(DCDCEN)*; U5 10(NC)*; U14 A5(PK20/MCSID-D1N/TWI2-SDA/UART6-RTS/NCSI-D4/PK-EINT20)* A8(PK14/MCSIC-D1N/UART7-RTS/UART5-RTS/NCSI-HSYNC/PK-EINT14)* A16(PH11/DMIC-DATA2/SPI2-MISO/I2S2-DOUT0/I2S2-DIN1/PCIE0-PERSTN/PH-EINT11)* AA1(GPADC8)* AA2(GPADC9)* AA3(GPADC10)* AA4(GPADC11)* AA5(GPADC12)* AA6(GPADC13)* AB2(GPADC14)* AB3(GPADC15)* AC2(GPADC16)* AC3(GPADC17)* AC4(GPADC18)* AC5(GPADC19)* AC6(GPADC20)* AD1(MICIN1N)* AD2(MICIN1P)* AE1(MICIN2N)* AE2(MICIN2P)* AE4(GPADC21)* AE5(GPADC22)* AE6(GPADC23)* AG1(LINEOUTLN)* AG2(LINEOUTLP)* AG13(PI1/TWI4-SDA/UART4-RX/PWM-2/I2S2-DIN2/I2S2-DOUT2/PI-EINT1)* AG17(PLLTEST)* AH1(LINEOUTRN)* AH2(LINEOUTRP)* AH11(TEST)* AH13(PI0/TWI4-SCK/UART4-TX/PWM-1/I2S2-DIN3/I2S2-DOUT3/PI-EINT0)* AH15(PI7/UART6-RX/UART4-CTS/PWM-8/SPI2-CLK/PI-EINT7)* AJ1(MIC-DET)* AJ15(PI5/UART5-CTS/SPI1-MISO/PWM-6/I2S2-DIN0/I2S2-DOUT1/PI-EINT5)* AK1(MBIAS)* AK13(WREQIN)* AK15(PI6/UART6-TX/UART4-RTS/PWM-7/SPI2-CS0/PI-EINT6)* AK33(SA0)* AL5(PM5/S-IR-RX/S-RJTAG-DI/S-TWI2-SDA/S-PWM-9/S-PM-EINT5)* AL7(PL5/S-JTAG-CK/S-CAN-RX0/S-PWM-5/I2S0-LRCK/DMIC-DATA3/S-PL-EINT5)* AL11(X32KFOUT)* AL15(PI2/UART5-TX/SPI1-CS0/PWM-3/I2S2-BCLK/PI-EINT2)* AL27(SA3)* AL32(SODT0)* AL33(SODT1)* AM6(PL3/S-UART0-RX/S-UART1-RX/S-PWM-3/S-PL-EINT3)* AM7(PL4/S-JTAG-MS/S-CAN-TX0/S-PWM-4/I2S0-BCLK/S-PL-EINT4)* AM8(PL7/S-JTAG-DI/S-PWM-7/I2S0-DOUT1/I2S0-DIN0/DMIC-DATA1/S-PL-EINT7)* AM14(REFCLK-OUT)* AM15(PI4/UART5-RTS/SPI1-MOSI/PWM-5/I2S2-DOUT0/I2S2-DIN1/PI-EINT4)* AM16(PI9/TWI5-SDA/DMIC-DATA2/PWM-10/PI-EINT9)* AM17(PI11/UART3-TX/DMIC-DATA0/PWM-12/PI-EINT11)* AM18(PI14/UART6-RTS/DMIC-CLK/PWM-15/PI-EINT14)* AM33(SA7)* AN4(PM4/S-PWM-8/S-RJTAG-DO/S-TWI2-SCK/S-PM-EINT4)* AN7(PL2/S-UART0-TX/S-UART1-TX/S-PWM-2/S-PL-EINT2)* AN8(PL6/S-JTAG-DO/S-PWM-6/I2S0-DIN1/I2S0-DOUT0/DMIC-DATA2/S-PL-EINT6)* AN15(PI3/UART5-RX/SPI1-CLK/PWM-4/I2S2-LRCK/PI-EINT3)* AN17(PI10/OWA-OUT/DMIC-DATA1/PWM-11/I2S2-MCLK/PI-EINT10)* AN26(SBG0)* B6(PK19/MCSID-D0P/TWI2-SCK/UART6-RX/NCSI-D3/PK-EINT19)* B7(PK16/MCSIC-CKN/TWI5-SCK/UART5-TX/NCSI-D0/PK-EINT16)* B8(PK15/MCSIC-D1P/UART7-CTS/UART5-CTS/NCSI-VSYNC/PK-EINT15)* B9(PK12/MCSIC-D0N/UART7-TX/TWI4-SCK/NCSI-PCLK/PK-EINT12)* B15(PH13/TWI3-SDA/I2S3-MCLK/RGMII0-EPHY-25M/PH-EINT13)* C7(PK17/MCSIC-CKP/TWI5-SDA/UART5-RX/NCSI-D1/PK-EINT17)* C9(PK13/MCSIC-D0P/UART7-RX/TWI4-SDA/NCSI-MCLK/PK-EINT13)* C15(PH12/DMIC-DATA3/TWI3-SCK/I2S2-DIN0/I2S2-DOUT1/PCIE0-WAKEN/PH-EINT12)* G4(PJ10/LCD1-D10/LVDS3-D0P/RGMII1-EPHY-25M/PJ-EINT10)* G16(JTAG-SEL)* J2(PJ17/LCD1-D17/LVDS3-CKN/PJ-EINT17)* M3(PJ24/LCD1-CLK/TWI4-SCK/UART4-TX/SPI0-CS1/PJ-EINT24)* N1(PJ27/LCD1-VSYNC/TWI5-SDA/UART4-CTS/PJ-EINT27)* N4(PJ18/LCD1-D18/LVDS3-D3P/PJ-EINT18)* N5(PJ19/LCD1-D19/LVDS3-D3N/PJ-EINT19)* N31(PB4/TWI1-SCK/I2S0-MCLK/TRACE-DATA2/PWM-8/HDMI-SCL/PB-EINT4)* N32(PB5/TWI1-SDA/I2S0-BCLK/TRACE-CLK/PWM-9/HDMI-SDA/PB-EINT5)* N33(PB6/I2S0-LRCK/TRACE-DATA0/PWM-10/HDMI-CEC/PB-EINT6)* U28(PC4/NAND-CE0/SPI0-MISO/SPIF-MISO/PC-EINT4)* U29(PC3/NAND-CE1/SPI0-CS0/SPIF-CS0/PC-EINT3)* U30(PC2/NAND-CLE/SPI0-MOSI/SPIF-MOSI/PC-EINT2)* U33(PC12/NAND-DQS/SPI0-CLK/SPIF-CLK/PC-EINT12)* W4(GPADC3)* W5(GPADC4)* W6(GPADC5)* W29(PC7/NAND-RB1/SPI0-CS1/SPIF-DQS/PC-EINT7)* Y2(GPADC6)* Y3(GPADC7)*; UD1 A1(NC0)* A2(NC1)* A11(NC2)* A12(NC3)* AA1(NC11)* AA12(NC12)* AB1(NC13)* AB2(NC14)* AB11(NC15)* AB12(NC16)* B1(NC4)* B12(NC5)* G11(NC6)* K5(NC7)* K8(NC8)* N5(NC9)* N8(NC10)*

## Notes on the sheets
sheet 1
- 1.8V
- 1.8V
- 0.9V
- 0.9V
- 0.9V
- FB远端反馈，靠近DRAM
- 1.8V
- 1.8V
- 1.8V
- 软件调整
- 1.8V
- 3.3V
- 3.3V
- 3.3V
- 1.8V
- 0.9V
- 0.9V
- 1.8V
sheet 2
- try default order:(selected fail media will not try)
  EMMC_USER->EMMC_BOOT->SLC NAND->MLC NAND->SPI NOR->SPI NAND
- JTAG-SEL默认为高电平，默认浮空；若要配置为低电平，直接接地即可。此信号为敏感信号，易
  受ESD等干扰，禁止在实际产品中引出一段浮空走线。
  TEST为内部测试引脚，实际应用请做悬空处理，禁止引出一段浮空走线。
  FEL/LRADC模块信号接按键时要接1nF去抖动电容，请勿删除或者更改为其他容值。
  BOOT_SEL_ADC为存储介质启动先后顺序配置脚，用于调整NAND和EMMC的启动顺序，可以
  根据产品的需求进行相关配置。T527默认开启BOOT_SEL_ADC pin识别启动顺序。
- R1
- R2
sheet 3
- T527支持DDR3/3L、DDR4、LPDDR3、LPDDR4、LPDDR4x，使用时需先确定DRAM的类型、片选及位宽
  DRAM上电时序请严格参照标案原理图设计。LPDDR3、LPDDR4、LPDDR4x颗粒需要的VDD18-LPDDR电源使用BLDO2供电；
  DDR4颗粒需要的VCC25-DRAM电源需外挂LDO供电，
  使用AXP717B BLDO2使能控制输出；LPDDR4x颗粒需要的VCC-DRAML电源需外挂DCDC供电，使用AXP717B BLDO2使能控制输出。
  DRAM外部分立器件的数量、值大小以及精度不允许随意更改，请严格参照标案原理图设计。
  DRAM所有的滤波电容不能删减，预留的滤波电容建议在开发阶段预留调试，但可以不贴片，待开发测试验证稳定之后，量产可以根据实际情况酌情删除
